# EasyEDA Pro project 硬触发测试_2024-02-21_17-27-05(1).eprj, board PCB1
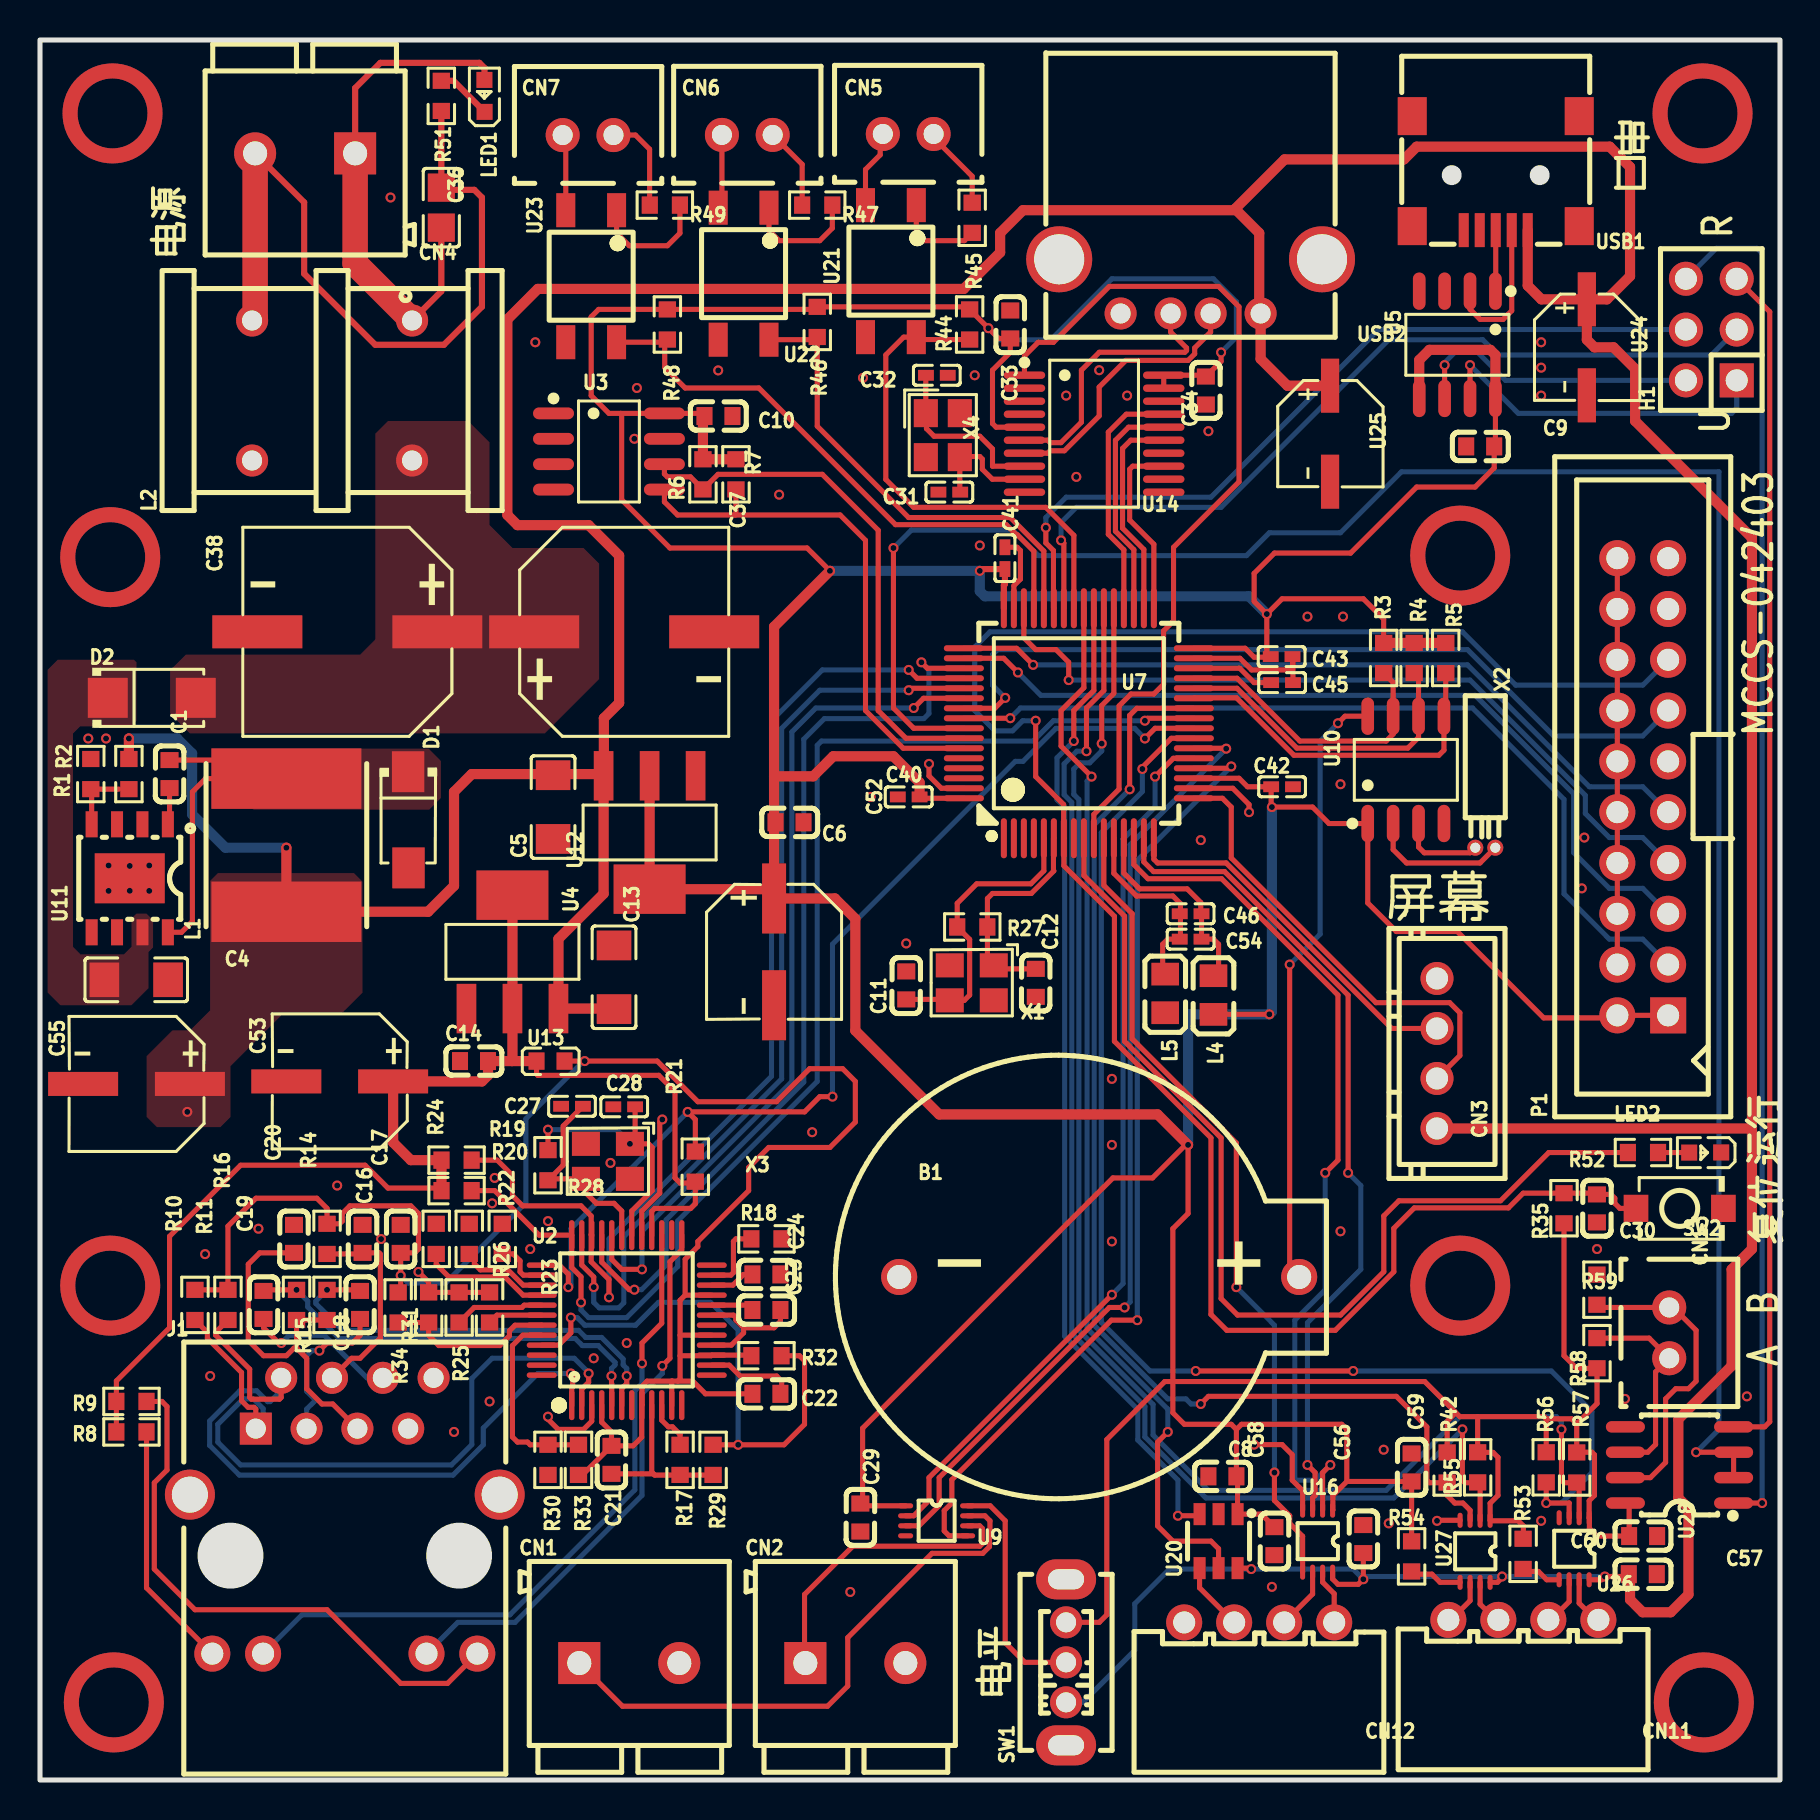
[diagram p6: board, top side]
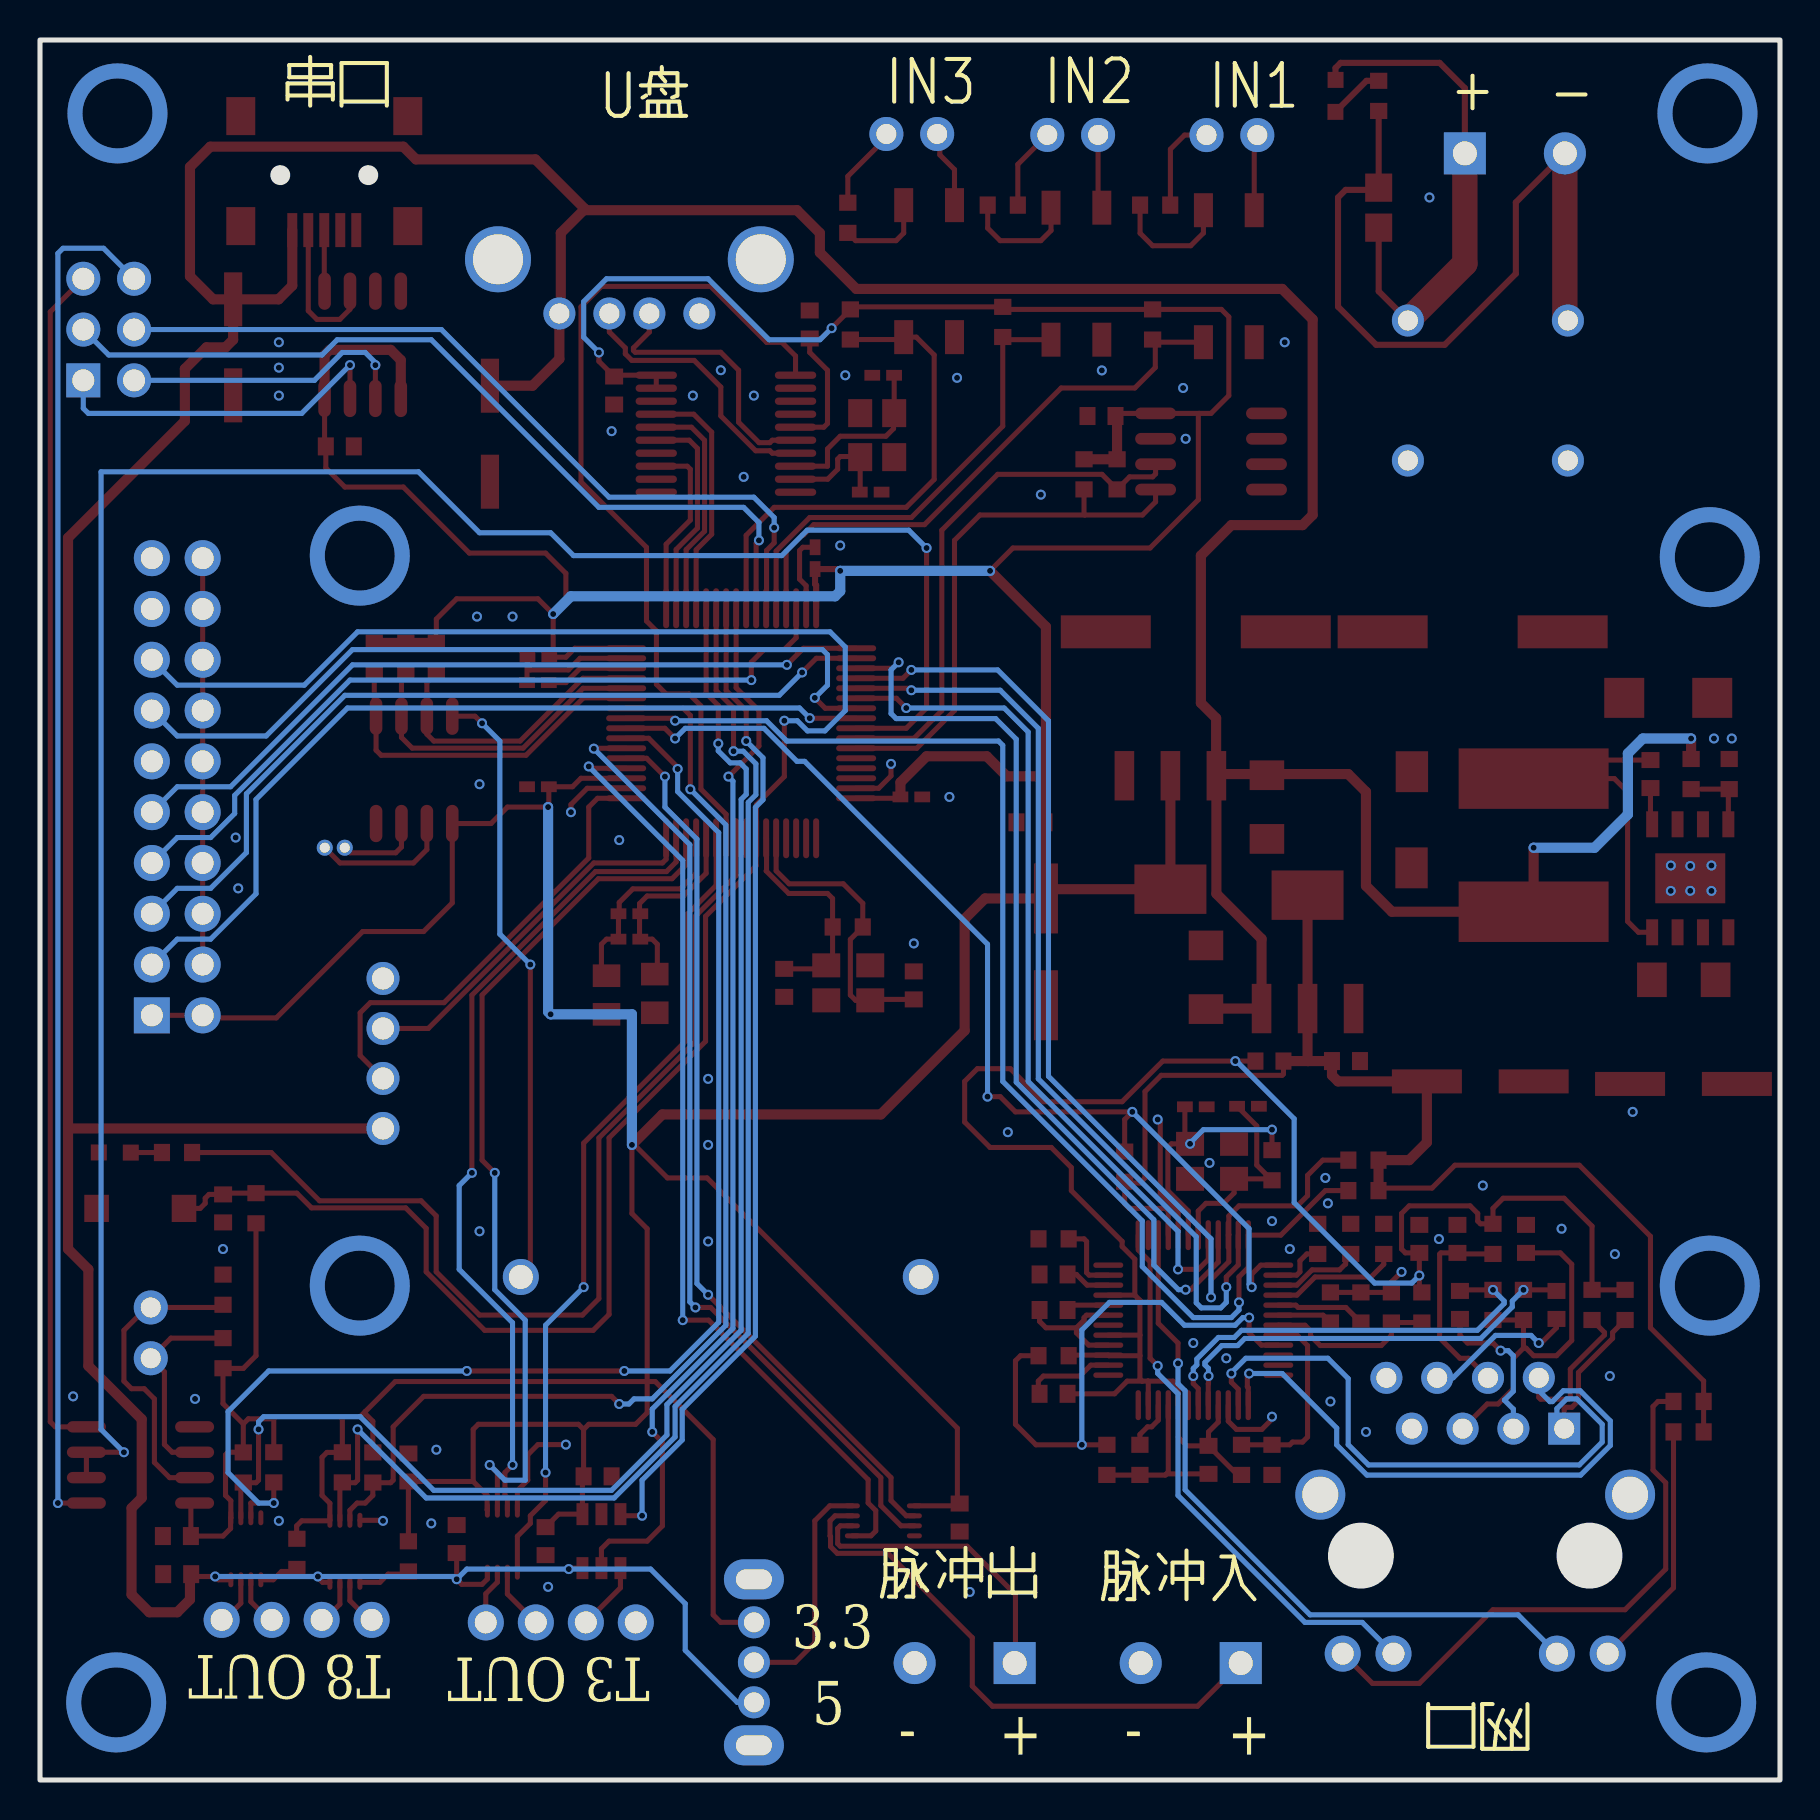
[diagram p7: board, bottom side, seen from below]

Outline 87 x 87 mm; copper layers: Top Layer, Bottom Layer. Coordinates in mm from the lower left corner of the outline.
Outline path: rectangle 0,87 87,0
Stack: Top Layer 0.035mm / Dielectric1 1.51mm FR4 er 4.5 / Bottom Layer 0.035mm

## Design rules (mm)
net $2N737: DP1
net $2N734: DP1
net TXN: DP2
net TXP: DP2
net RXN: DP4
net RXP: DP4
net RXPNET: DP3
net RXNNET: DP3
template: JLCPCB Capability(Two Layers Board)
spacing copperThickness1oz (default): track to track 0.102, other pairs 0.152 to 0.3
spacing copperThickness2oz: track to track 0.203, other pairs 0.152 to 0.3
track width copperThickness1oz (default): min 0.127, default 0.254, max 2.54
track width copperThickness2oz: min 0.203, default 0.254, max 2.54
differential pair differentialPair (default): width min 0.127, default 0.254, max 2.54; gap min 0.152, default 0.152
via viaSize (default): diameter min 0.5, default 0.61, max 10; hole min 0.3, default 0.305, max 6.3

## Placement (name value [footprint] x y rotation side)
B1  BS-02-A1AJ010  [BAT-TH_BS-02-A1AJ010]  52.96 25.15 0 top
C1  10nF  [C0603]  6.48 50.3 270 top
C4  10uF  [C1206]  4.81 40.01 180 top
C5  10uF  [C1206]  25.65 48.65 90 top
C6  100nF  [C0603]  37.48 47.88 180 top
C8  100nF  [C0603]  59.12 15.18 180 top
C9  100nF  [C0603]  72.01 66.68 180 top
C10  100nF  [C0603]  33.92 68.2 0 top
C11  20pF  [C0603]  43.31 39.73 90 top
C12  20pF  [C0603]  49.79 39.86 90 top
C13  10uF  [C1206]  28.7 40.14 270 top
C14  100nF  [C0603]  21.7 35.95 0 top
C16  22nF  [C0603]  16.13 27.06 90 top
C17  100nF  [C0603]  18.03 27.06 90 top
C18  6.8nF  [C0603]  16 23.75 270 top
C19  6.8nF  [C0603]  11.18 23.75 270 top
C20  10nF  [C0603]  12.7 27.06 90 top
C21  100nF  [C0603]  28.57 16.01 90 top
C22  100nF  [C0603]  36.32 19.31 180 top
C23  4.7uF  [C0603]  36.32 23.5 180 top
C24  10nF  [C0603]  36.32 25.28 180 top
C27  18pF  [C0402]  26.6 33.69 180 top
C28  18pF  [C0402]  29.21 33.66 0 top
C29  100nF  [C0603]  41.02 13.12 270 top
C30  100nF  [C0603]  77.84 28.58 270 top
C31  12pF  [C0402]  45.47 64.39 0 top
C32  12pF  [C0402]  44.84 70.24 180 top
C33  100nF  [C0603]  48.51 72.78 90 top
C34  100nF  [C0603]  58.29 69.47 270 top
C36  10uF  [C0805]  20.07 78.62 270 top
C37  470uF  [CAP-SMD_BD10.0-L10.3-W10.3-LS11.0-FD]  29.21 57.41 0 top
C38  470uF  [CAP-SMD_BD10.0-L10.3-W10.3-LS11.0-FD]  15.37 57.41 180 top
C40  100nF  [C0402]  43.43 49.15 0 top
C41  100nF  [C0402]  48.25 61.09 270 top
C42  100nF  [C0402]  62.1 49.66 180 top
C43  100nF  [C0402]  62.08 56.17 180 top
C45  2.2uF  [C0402]  62.1 54.87 180 top
C46  100nF  [C0402]  57.53 43.31 0 top
C52  220uF  [CAP-SMD_BD6.3-L6.6-W6.6-FD]  36.7 41.41 270 top
C53  220uF  [CAP-SMD_BD6.3-L6.6-W6.6-FD]  14.99 34.93 180 top
C54  100nF  [C0402]  57.53 42.04 0 top
C55  220uF  [CAP-SMD_BD6.3-L6.6-W6.6-FD]  4.83 34.8 180 top
C56  100nF  [C0603]  66.17 12.05 270 top
C57  100nF  [C0603]  80.14 10.29 180 top
C58  100nF  [C0603]  61.72 11.94 270 top
C59  100nF  [C0603]  68.58 15.63 270 top
C60  100nF  [C0603]  80.16 12.2 0 top
CN1  XY118-5.0-2P  [CONN-TH_XY118-5.0-2P]  29.46 5.85 0 top
CN2  XY118-5.0-2P  [CONN-TH_XY118-5.0-2P]  40.77 5.85 0 top
CN3  XH-4A  [CONN-TH_XH2.50-4P]  69.85 36.33 90 top
CN4  XY118-5.0-2P  [CONN-TH_XY118-5.0-2P]  13.26 81.33 180 top
CN5  B2B-XH-A(LF)(SN)  [CONN-TH_B2B-XH-A-LF-SN]  43.41 82.3 0 top
CN6  B2B-XH-A(LF)(SN)  [CONN-TH_B2B-XH-A-LF-SN]  35.37 82.25 0 top
CN7  B2B-XH-A(LF)(SN)  [CONN-TH_B2B-XH-A-LF-SN]  27.4 82.25 0 top
CN11  XH-4AW  [CONN-TH_XH2.54-4AW]  74.17 8.01 180 top
CN12  XH-4AW  [CONN-TH_XH2.54-4AW]  60.96 7.88 180 top
CN13  B2B-XH-A(LF)(SN)  [CONN-TH_B2B-XH-A-LF-SN]  81.46 22.36 270 top
D1  B340A  [SMA_L4.3-W2.6-LS5.0-RD]  18.42 48.01 270 top
D2  SS34  [SMA_L4.3-W2.6-LS5.2-RD]  5.59 54.11 0 top
H1  PZ254V-12-6P  [HDR-TH_6P-P2.54-V-M-R2-C3-S2.54]  83.57 72.52 90 top
J1  HR911105A  [RJ45-TH_HR911105A]  15.24 13.21 0 top
L1  15uH  [IND-SMD_L8.0-W8.0]  12.32 46.74 90 top
L2  UU9.8-10mH  [FILTER-TH_4P-L17.0-W12.0-P7.00-D0.6-S8.00]  14.61 69.47 90 top
L4  100uH  [L0805]  58.67 39.25 90 top
L5  100uH  [L0805]  56.26 39.33 90 top
LED1  XL-1608SURC-06  [LED0603-RD_RED]  22.22 84.21 90 top
LED2  XL-1608SURC-06  [LED0603-RD_RED]  83.26 31.37 180 top
P1  2.54-2*10P简牛  [IDC-TH_20P-P2.54-V-R2-C10-S2.54]  80.14 49.66 90 top
R1  10kΩ  [R0603]  4.44 50.3 90 top
R2  3.24kΩ  [R0603]  2.54 50.3 270 top
R3  4.7kΩ  [R0603]  67.18 56.1 90 top
R4  4.7kΩ  [R0603]  68.71 56.1 90 top
R5  4.7kΩ  [R0603]  70.29 56.1 90 top
R6  2.2kΩ  [R0603]  33.15 65.28 270 top
R7  2.2kΩ  [R0603]  34.8 65.28 270 top
R8  1kΩ  [R0603]  4.57 17.4 0 top
R9  1kΩ  [R0603]  4.57 18.93 0 top
R10  51Ω  [R0603]  7.75 23.75 270 top
R11  51Ω  [R0603]  9.4 23.75 270 top
R14  10Ω  [R0603]  14.35 27.06 270 top
R15  82Ω  [R0603]  14.35 23.75 270 top
R16  82Ω  [R0603]  12.83 23.75 270 top
R17  12.4kΩ  [R0603]  32 16.01 90 top
R18  10kΩ  [R0603]  36.32 27.06 180 top
R19  10kΩ  [R0603]  20.83 30.99 180 top
R20  10kΩ  [R0603]  20.83 29.47 180 top
R21  10kΩ  [R0603]  32.77 30.67 270 top
R22  10kΩ  [R0603]  23.11 27.06 90 top
R23  10kΩ  [R0603]  21.46 27.06 90 top
R24  10kΩ  [R0603]  19.81 27.06 90 top
R25  10kΩ  [R0603]  20.95 23.63 90 top
R26  10kΩ  [R0603]  22.48 23.63 90 top
R27  1MΩ  [R0603]  46.61 42.65 180 top
R28  1MΩ  [R0603]  25.4 30.74 270 top
R29  10kΩ  [R0603]  33.66 16.01 90 top
R30  10kΩ  [R0603]  25.4 16.01 90 top
R31  10kΩ  [R0603]  19.43 23.63 270 top
R32  10kΩ  [R0603]  36.32 21.21 180 top
R33  10kΩ  [R0603]  26.92 16.01 270 top
R34  10kΩ  [R0603]  17.91 23.63 90 top
R35  10kΩ  [R0603]  76.2 28.59 270 top
R42  2.2kΩ  [R0603]  70.36 15.63 90 top
R44  2.2kΩ  [R0603]  46.48 72.78 90 top
R45  2.2kΩ  [R0603]  46.61 78.11 90 top
R46  2.2kΩ  [R0603]  38.86 72.9 90 top
R47  2.2kΩ  [R0603]  38.86 78.75 180 top
R48  2.2kΩ  [R0603]  31.37 72.78 90 top
R49  2.2kΩ  [R0603]  31.24 78.75 180 top
R51  4.7kΩ  [R0603]  20.07 84.21 90 top
R52  2.2kΩ  [R0603]  80.15 31.37 0 top
R53  1kΩ  [R0603]  74.16 11.31 270 top
R54  1kΩ  [R0603]  68.58 11.18 270 top
R55  2.2kΩ  [R0603]  71.88 15.63 90 top
R56  2.2kΩ  [R0603]  75.31 15.63 90 top
R57  2.2kΩ  [R0603]  76.84 15.63 90 top
R58  4.7kΩ  [R0603]  77.85 21.34 270 top
R59  4.7kΩ  [R0603]  77.85 24.52 90 top
SW1  SS12D07VG4 087  [SW-TH_SS12D07VG4]  51.3 5.88 90 top
SW2  TS-1088-AR02016  [SW-SMD_L3.9-W3.0-P4.45]  81.99 28.58 0 top
U2  W5500  [LQFP-48_L7.0-W7.0-P0.50-LS9.0-BL]  29.34 22.99 0 top
U3  AT24C256C-SSHL-T  [SOIC-8_L4.9-W3.9-P1.27-LS6.0-BL]  28.45 66.43 270 top
U4  AMS1117-3.3  [SOT-223-4_L6.5-W3.5-P2.30-LS7.0-BR]  30.48 47.38 90 top
U5  CH340N  [SOP-8_L4.9-W3.9-P1.27-LS6.0-BL]  70.87 71.76 180 top
U7  STM32F412RET6  [LQFP-64_L10.0-W10.0-P0.50-LS12.0-BL]  51.94 52.84 0 top
U9  SN74LVC2T45DCUR  [VSSOP-8_L2.4-W2.1-P0.50-LS3.2-BR]  44.83 12.96 180 top
U10  DS1302ZM/TR  [SOP-8_L4.9-W3.9-P1.27-LS6.0-BL]  68.29 50.51 0 top
U11  TPS5430DDAR  [ESOP-8_L4.9-W3.9-P1.27-LS6.0-TL-EP]  4.49 45.08 270 top
U12  AMS1117-3.3  [SOT-223-4_L6.5-W3.5-P2.30-LS7.0-BR]  23.62 41.41 270 top
U13  1uH  [L0603]  25.53 35.95 180 top
U14  CH374T  [SSOP-20_L7.5-W5.2-P0.65-LS8.0-BL]  52.71 67.31 270 top
U16  SN74LVC2T45DCUR  [VSSOP-8_L2.4-W2.1-P0.50-LS3.2-BR]  63.88 11.94 90 top
U20  SN74LVC1T45DBVR  [SOT-23-6_L2.9-W1.6-P0.95-LS2.8-BR]  58.93 11.94 90 top
U21  EL357N(C)(TA)-G  [OPTO-SMD-4_L4.4-W4.1-P2.54-LS7.0-TL]  42.54 75.44 270 top
U22  EL357N(C)(TA)-G  [OPTO-SMD-4_L4.4-W4.1-P2.54-LS7.0-TL]  35.18 75.32 270 top
U23  EL357N(C)(TA)-G  [OPTO-SMD-4_L4.4-W4.1-P2.54-LS7.0-TL]  27.56 75.19 270 top
U24  100uF  [CAP-SMD_BD5.0-L5.3-W5.3-LS6.3-FD]  77.34 71.63 270 top
U25  100uF  [CAP-SMD_BD5.0-L5.3-W5.3-LS6.3-FD]  64.5 67.31 270 top
U26  SN74LVC2T45DCUR  [VSSOP-8_L2.4-W2.1-P0.50-LS3.2-BR]  76.71 11.56 90 top
U27  SN74LVC2T45DCUR  [VSSOP-8_L2.4-W2.1-P0.50-LS3.2-BR]  71.75 11.44 90 top
U28  SP3485EN-L/TR  [SOIC-8_L5.0-W4.0-P1.27-LS6.0-BL]  81.98 15.75 90 top
USB1  UX-144S-ACP5  [MINI-USB-SMD_UX-144S-ACP5]  72.79 80.34 180 top
USB2  USB-231-ARY  [USB-A-TH_USB-231-ARY]  57.53 74.68 180 top
X1  25MHz  [OSC-SMD_4P-L3.2-W2.5-BL]  46.59 39.86 180 top
X2  32.768kHz  [OSC-TH_BD2.0-P0.70-D0.3]  72.26 46.61 270 top
X3  25MHz  [OSC-SMD_4P-L3.2-W2.5-BL]  28.4 30.93 180 top
X4  24MHz  [CRYSTAL-SMD_4P-L3.2-W2.5-BL]  45.14 67.24 270 top

## Footprints (pads in the part's own frame, mm; a bottom-side part is the same pattern mirrored in y, then rotated)
BAT-TH_BS-02-A1AJ010
  round 1.8 hole 1.2: 1(-10,0) 2(10,0)
C0402
  rect 0.79x0.54 smd: 1(-0.545,0) 2(0.545,0)
C0603
  rect 0.8x0.9 smd: 1(-0.7,0) 2(0.7,0)
C0805
  rect 1.41x1.35 smd: 1(-1,0) 2(1,0)
C1206
  rect 1.485x1.728 smd: 1(-1.593,0) 2(1.593,0)
CAP-SMD_BD5.0-L5.3-W5.3-LS6.3-FD
  rect 2.7x0.91 smd: 1(-2.4,0) 2(2.4,0)
CAP-SMD_BD6.3-L6.6-W6.6-FD
  rect 3.5x1.2 smd: 1(-2.67,0) 2(2.67,0)
CAP-SMD_BD10.0-L10.3-W10.3-LS11.0-FD
  rect 4.5x1.65 smd: 1(-4.5,0) 2(4.5,0)
CONN-TH_B2B-XH-A-LF-SN
  round 1.7 hole 1: 1(1.27,0) 2(-1.27,0)
CONN-TH_XH2.50-4P
  round 1.65 hole 1.1: 1(-3.75,0) 2(-1.25,0) 3(1.25,0) 4(3.75,0)
CONN-TH_XH2.54-4AW
  round 1.8 hole 1.1: 1(-3.751,0) 2(-1.248,0) 3(1.251,0) 4(3.751,0)
CONN-TH_XY118-5.0-2P
  rect 2.1x2.1 hole 1.2: 1(-2.5,0)
  round 2.1 hole 1.2: 2(2.5,0)
CRYSTAL-SMD_4P-L3.2-W2.5-BL
  rect 1.4x1.2 smd: 1(-1.1,-0.85) 2(1.1,-0.85) 3(1.1,0.85) 4(-1.1,0.85)
ESOP-8_L4.9-W3.9-P1.27-LS6.0-TL-EP
  rect 1.3x0.6 smd: 1(-2.7,1.905) 2(-2.7,0.635) 3(-2.7,-0.635) 4(-2.7,-1.905) 5(2.7,-1.905) 6(2.7,-0.635) 7(2.7,0.635) 8(2.7,1.905)
  rect 2.5x3.5 smd: 9(0,0)
FILTER-TH_4P-L17.0-W12.0-P7.00-D0.6-S8.00
  round 1.6 hole 1: 1(3.5,-4) 2(-3.5,-4) 3(-3.5,4) 4(3.5,4)
HDR-TH_6P-P2.54-V-M-R2-C3-S2.54
  rect 1.7x1.7 hole 1.1: 1(-2.54,-1.27)
  round 1.7 hole 1.1: 2(-2.54,1.27) 3(0,-1.27) 4(0,1.27) 5(2.54,-1.27) 6(2.54,1.27)
IDC-TH_20P-P2.54-V-R2-C10-S2.54
  rect 1.8x1.8 hole 1.1: 1(-11.43,-1.27)
  round 1.8 hole 1.1: 2(-11.43,1.27) 3(-8.89,-1.27) 4(-8.89,1.27) 5(-6.35,-1.27) 6(-6.35,1.27) 7(-3.81,-1.27) 8(-3.81,1.27) 9(-1.27,-1.27) 10(-1.27,1.27) 11(1.27,-1.27) 12(1.27,1.27) 13(3.81,-1.27) 14(3.81,1.27) 15(6.35,-1.27) 16(6.35,1.27) 17(8.89,-1.27) 18(8.89,1.27) 19(11.43,-1.27) 20(11.43,1.27)
IND-SMD_L8.0-W8.0
  rect 3.024x7.5 smd: 1(3.328,0) 2(-3.328,0)
L0603
  rect 0.8x0.864 smd: 1(-0.7,0) 2(0.7,0)
L0805
  rect 1.133x1.377 smd: 1(-0.966,0) 2(0.966,0)
LED0603-RD_RED
  rect 0.8x0.8 smd: 1(-0.799,-0.004) 2(0.799,0.004)
LQFP-48_L7.0-W7.0-P0.50-LS9.0-BL
  oval 0.27x1.5 smd: 1(-2.75,-4.25) 2(-2.25,-4.25) 3(-1.75,-4.25) 4(-1.25,-4.25) 5(-0.75,-4.25) 6(-0.25,-4.25) 7(0.25,-4.25) 8(0.75,-4.25) 9(1.25,-4.25) 10(1.75,-4.25) 11(2.25,-4.25) 12(2.75,-4.25) 25(2.75,4.25) 26(2.25,4.25) 27(1.75,4.25) 28(1.25,4.25) 29(0.75,4.25) 30(0.25,4.25) 31(-0.25,4.25) 32(-0.75,4.25) 33(-1.25,4.25) 34(-1.75,4.25) 35(-2.25,4.25) 36(-2.75,4.25)
  oval 1.5x0.27 smd: 13(4.25,-2.75) 14(4.25,-2.25) 15(4.25,-1.75) 16(4.25,-1.25) 17(4.25,-0.75) 18(4.25,-0.25) 19(4.25,0.25) 20(4.25,0.75) 21(4.25,1.25) 22(4.25,1.75) 23(4.25,2.25) 24(4.25,2.75) 37(-4.25,2.75) 38(-4.25,2.25) 39(-4.25,1.75) 40(-4.25,1.25) 41(-4.25,0.75) 42(-4.25,0.25) 43(-4.25,-0.25) 44(-4.25,-0.75) 45(-4.25,-1.25) 46(-4.25,-1.75) 47(-4.25,-2.25) 48(-4.25,-2.75)
LQFP-64_L10.0-W10.0-P0.50-LS12.0-BL
  oval 0.3x2 smd: 1(-3.75,-5.75) 2(-3.25,-5.75) 3(-2.75,-5.75) 4(-2.25,-5.75) 5(-1.75,-5.75) 6(-1.25,-5.75) 7(-0.75,-5.75) 8(-0.25,-5.75) 9(0.25,-5.75) 10(0.75,-5.75) 11(1.25,-5.75) 12(1.75,-5.75) 13(2.25,-5.75) 14(2.75,-5.75) 15(3.25,-5.75) 16(3.75,-5.75) 33(3.75,5.75) 34(3.25,5.75) 35(2.75,5.75) 36(2.25,5.75) 37(1.75,5.75) 38(1.25,5.75) 39(0.75,5.75) 40(0.25,5.75) 41(-0.25,5.75) 42(-0.75,5.75) 43(-1.25,5.75) 44(-1.75,5.75) 45(-2.25,5.75) 46(-2.75,5.75) 47(-3.25,5.75) 48(-3.75,5.75)
  oval 2x0.3 smd: 17(5.75,-3.75) 18(5.75,-3.25) 19(5.75,-2.75) 20(5.75,-2.25) 21(5.75,-1.75) 22(5.75,-1.25) 23(5.75,-0.75) 24(5.75,-0.25) 25(5.75,0.25) 26(5.75,0.75) 27(5.75,1.25) 28(5.75,1.75) 29(5.75,2.25) 30(5.75,2.75) 31(5.75,3.25) 32(5.75,3.75) 49(-5.75,3.75) 50(-5.75,3.25) 51(-5.75,2.75) 52(-5.75,2.25) 53(-5.75,1.75) 54(-5.75,1.25) 55(-5.75,0.75) 56(-5.75,0.25) 57(-5.75,-0.25) 58(-5.75,-0.75) 59(-5.75,-1.25) 60(-5.75,-1.75) 61(-5.75,-2.25) 62(-5.75,-2.75) 63(-5.75,-3.25) 64(-5.75,-3.75)
MINI-USB-SMD_UX-144S-ACP5
  rect 0.5x1.7 smd: 1(-1.6,2.85) 2(-0.8,2.85) 3(0,2.85) 4(0.8,2.85) 5(1.6,2.85)
  rect 1.45x1.9 smd: 6(-4.175,2.65) 7(-4.175,-2.85) 8(4.175,-2.85) 9(4.175,2.65)
OPTO-SMD-4_L4.4-W4.1-P2.54-LS7.0-TL
  rect 1.7x0.95 smd: 1(-3.3,1.27) 2(-3.3,-1.27) 3(3.3,-1.27) 4(3.3,1.27)
OSC-SMD_4P-L3.2-W2.5-BL
  rect 1.4x1.2 smd: 1(-1.1,-0.875) 2(1.1,-0.875) 3(1.1,0.875) 4(-1.1,0.875)
OSC-TH_BD2.0-P0.70-D0.3
  round 0.8 hole 0.5: 1(0,0.5) 2(0,-0.5)
R0603
  rect 0.806x0.864 smd: 1(-0.753,0) 2(0.753,0)
RJ45-TH_HR911105A
  rect 1.6x1.6 hole 1: 1(-4.45,4.355)
  round 1.6 hole 1: 2(-3.18,6.895) 3(-1.91,4.355) 4(-0.64,6.895) 5(0.63,4.355) 6(1.9,6.895) 7(3.17,4.355) 8(4.44,6.895)
  round 1.8 hole 1.1: 9(-6.625,-6.895) 10(-4.085,-6.895) 11(4.085,-6.895) 12(6.625,-6.895)
  round 2.5 hole 1.8: SH1(-7.745,1.055) SH2(7.745,1.055)
SMA_L4.3-W2.6-LS5.0-RD
  rect 2.046x1.62 smd: 1(-2.404,-0.009) 2(2.404,0.009)
SMA_L4.3-W2.6-LS5.2-RD
  rect 2x2 smd: 1(-2.2,0) 2(2.2,0)
SOIC-8_L4.9-W3.9-P1.27-LS6.0-BL
  oval 0.588x2.045 smd: 1(-1.905,-2.772) 2(-0.635,-2.772) 3(0.635,-2.772) 4(1.905,-2.772) 5(1.905,2.772) 6(0.635,2.772) 7(-0.635,2.772) 8(-1.905,2.772)
SOIC-8_L5.0-W4.0-P1.27-LS6.0-BL
  oval 0.569x1.95 smd: 1(-1.905,-2.705) 2(-0.635,-2.705) 3(0.635,-2.705) 4(1.905,-2.705) 5(1.905,2.705) 6(0.635,2.705) 7(-0.635,2.705) 8(-1.905,2.705)
SOP-8_L4.9-W3.9-P1.27-LS6.0-BL
  oval 0.63x1.865 smd: 1(-1.905,-2.683) 2(-0.635,-2.683) 3(0.635,-2.683) 4(1.905,-2.683) 5(1.905,2.683) 6(0.635,2.683) 7(-0.635,2.683) 8(-1.905,2.683)
SOT-23-6_L2.9-W1.6-P0.95-LS2.8-BR
  rect 1.1x0.6 smd: 1(1.35,-0.95) 2(1.35,0) 3(1.35,0.95) 4(-1.35,0.95) 5(-1.35,0) 6(-1.35,-0.95)
SOT-223-4_L6.5-W3.5-P2.30-LS7.0-BR
  rect 2.47x0.98 smd: 1(2.835,-2.3) 2(2.835,0) 3(2.835,2.3)
  rect 2.47x3.6 smd: 4(-2.835,0)
SSOP-20_L7.5-W5.2-P0.65-LS8.0-BL
  oval 0.364x2.069 smd: 1(-2.925,-3.482) 2(-2.275,-3.482) 3(-1.625,-3.482) 4(-0.975,-3.482) 5(-0.325,-3.482) 6(0.325,-3.482) 7(0.975,-3.482) 8(1.625,-3.482) 9(2.275,-3.482) 10(2.925,-3.482) 11(2.925,3.482) 12(2.275,3.482) 13(1.625,3.482) 14(0.975,3.482) 15(0.325,3.482) 16(-0.325,3.482) 17(-0.975,3.482) 18(-1.625,3.482) 19(-2.275,3.482) 20(-2.925,3.482)
SW-SMD_L3.9-W3.0-P4.45
  rect 1.23x1.36 smd: 1(-2.185,0) 2(2.185,0)
SW-TH_SS12D07VG4
  oval 1.6x1.6 hole 1: 1(-2,0) 2(0,0) 3(2,0)
  oval 2x3 hole 1x1.8: 4(4.15,0) 5(-4.15,0)
USB-A-TH_USB-231-ARY
  round 1.6 hole 1: 1(-3.5,1.355) 2(-1,1.355) 3(1,1.355) 4(3.5,1.355)
  round 3.3 hole 2.5: 5(-6.57,-1.355) 6(6.57,-1.355)
VSSOP-8_L2.4-W2.1-P0.50-LS3.2-BR
  oval 0.75x0.25 smd: 1(1.55,-0.75) 2(1.55,-0.25) 3(1.55,0.25) 4(1.55,0.75) 5(-1.55,0.75) 6(-1.55,0.25) 7(-1.55,-0.25) 8(-1.55,-0.75)

## Nets
As in the schematic.

Pads without a net: J1 7 8; P1 11 17 19; U2 7 12 13 18 24 26 46 47; U5 4; U7 1 2 3 4 8 60 61 62; U11 2 3 5; U14 4 10 11 12 14; USB1 4

## Via types
v1: diameter 0.5, hole 0.3, Top Layer to Bottom Layer, 153 vias
v2: diameter 5, hole 3.5, Top Layer to Bottom Layer, 8 vias
